# EasyEDA Pro project DartCharger.eprj, board PCB1
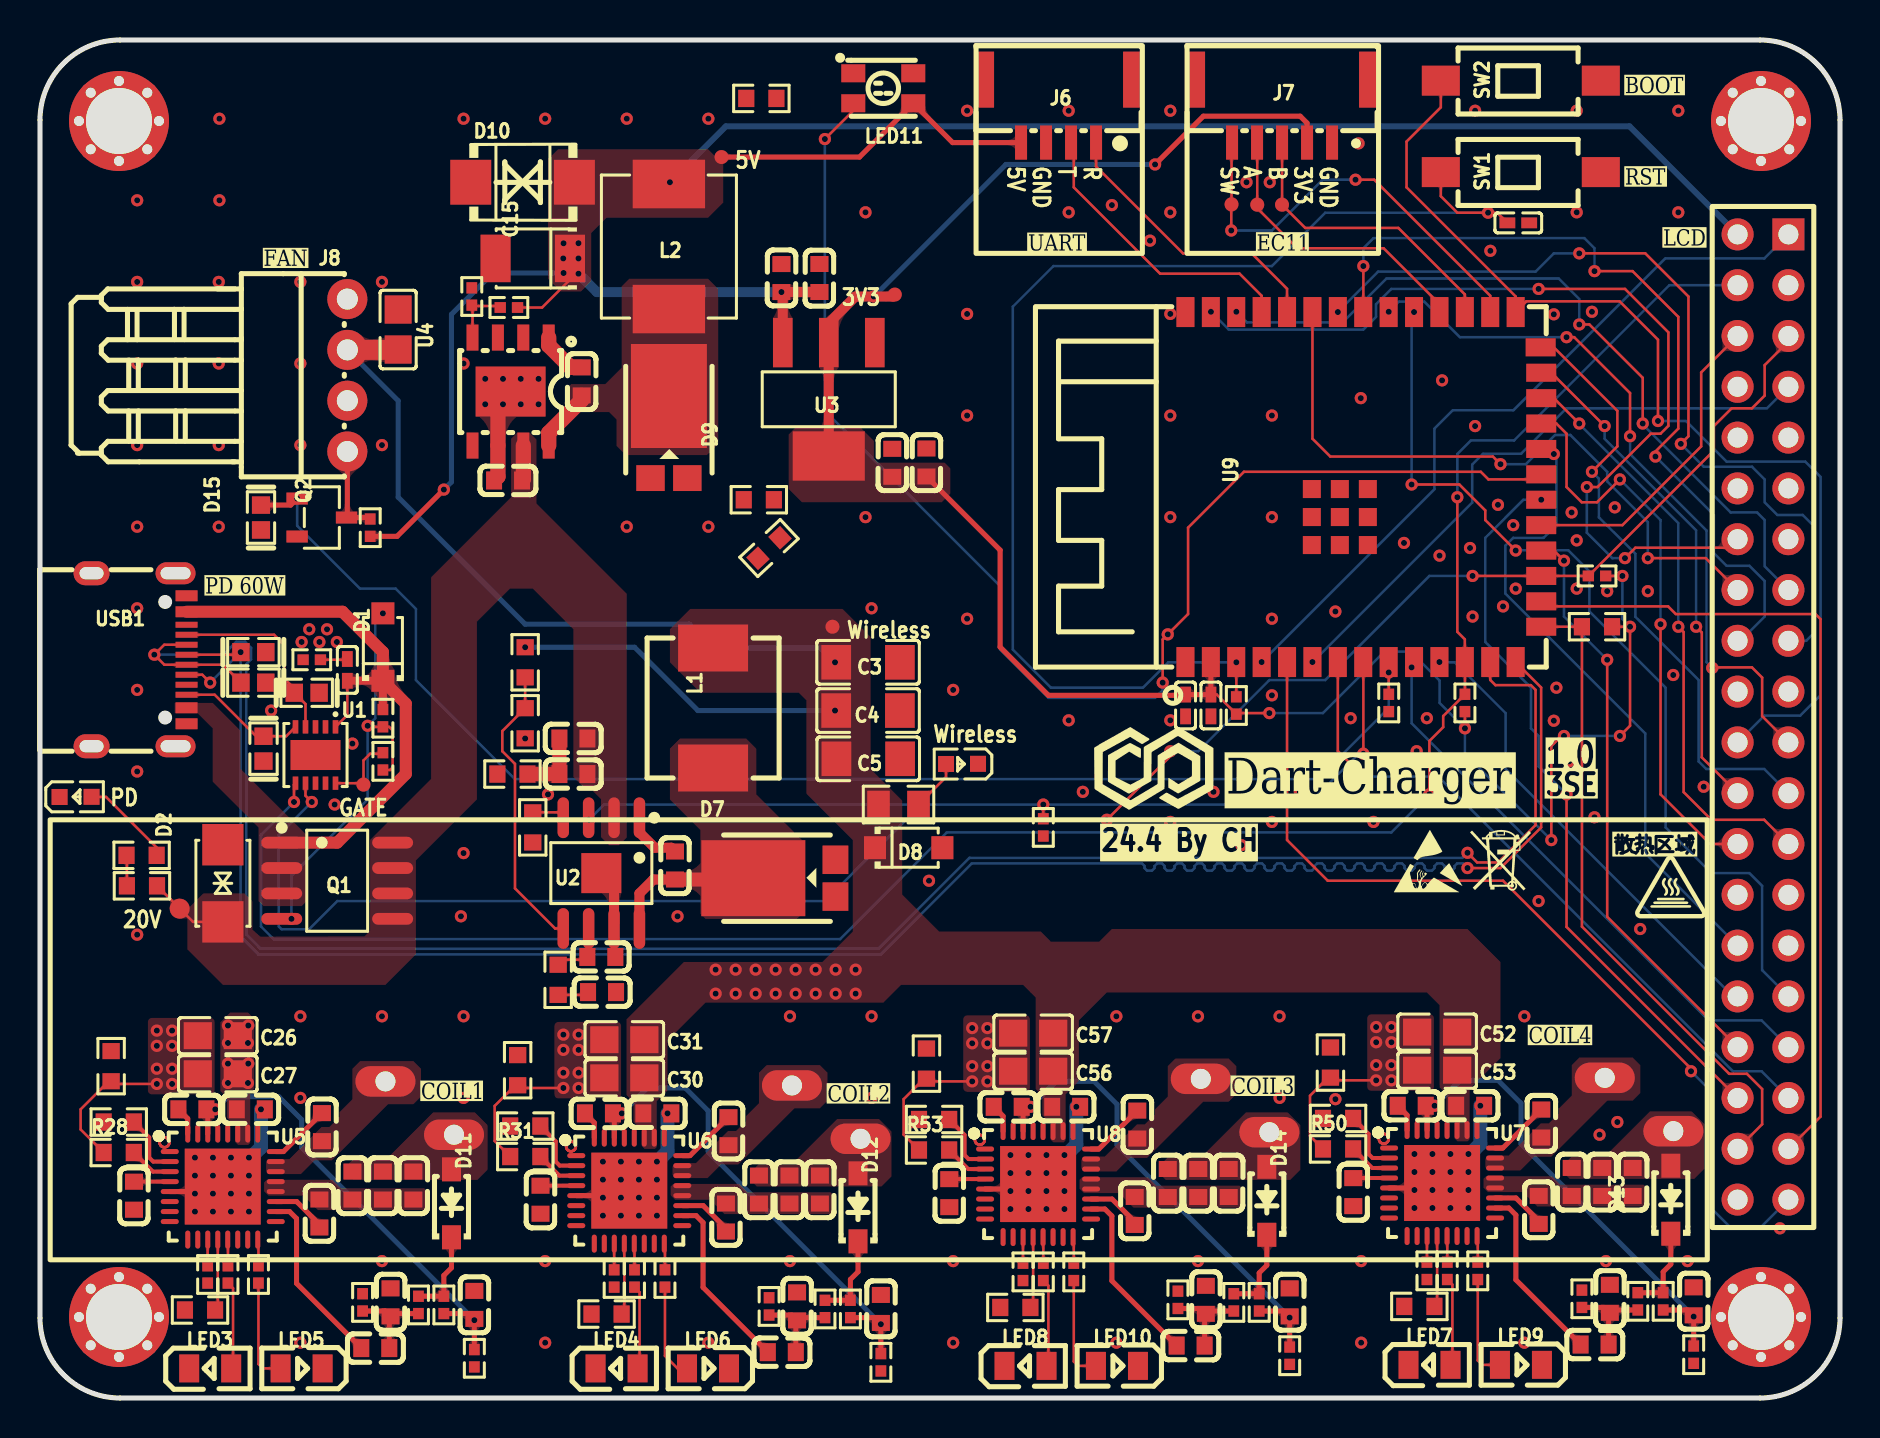
[diagram p3: board, top side]
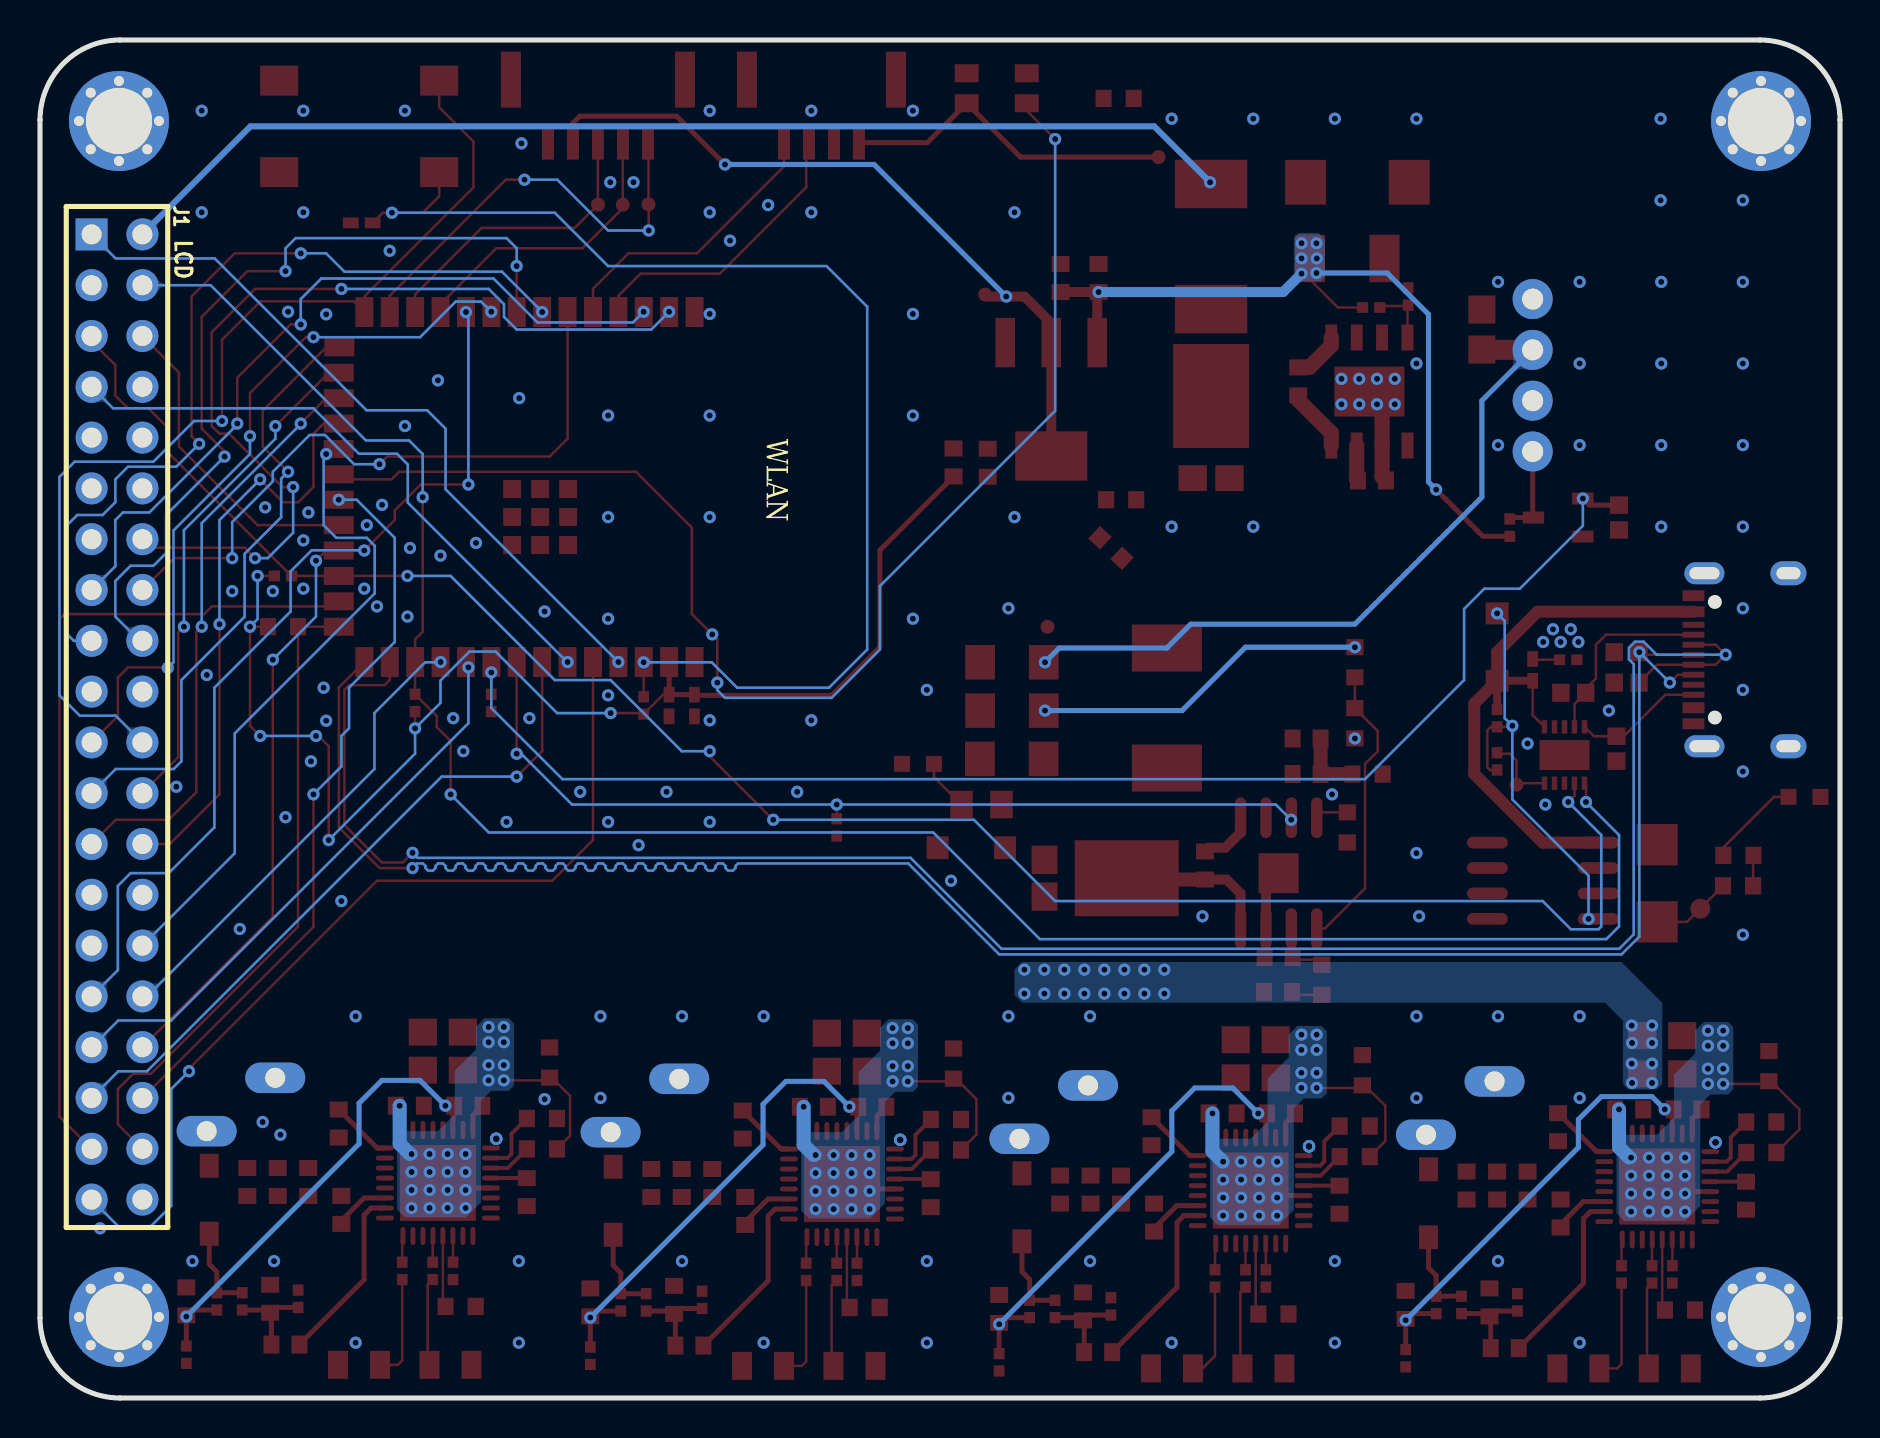
[diagram p4: board, bottom side, seen from below]

Outline 90 x 67.9 mm; copper layers: Top Layer, Bottom Layer. Coordinates in mm from the lower left corner of the outline.
Outline path: 0,63.9 0,4 arc(1.17,1.17) 4,0 86,0 arc(88.83,1.17) 90,4 90,63.9 arc(88.83,66.73) 86,67.9 4,67.9 arc(1.17,66.73) 0,63.9
Stack: Top Layer 0.035mm / Dielectric1 1.51mm FR4 er 4.5 / Bottom Layer 0.035mm

## Design rules (mm)
net USB_DN: DP1
net USB_DP: DP1
template: 自定义配置
spacing copperThickness1oz (default): track to track 0.102, other pairs 0.152 to 0.3
spacing copperThickness2oz: track to track 0.203, other pairs 0.152 to 0.3
track width copperThickness1oz (default): min 0.127, default 0.254, max 2.54
track width copperThickness2oz: min 0.203, default 0.254, max 2.54
differential pair differentialPair (default): width min 0.127, default 0.254, max 2.54; gap min 0.152, default 0.152
via viaSize (default): diameter min 0.5, default 0.61, max 10; hole min 0.3, default 0.305, max 6.3
net PGND uses copperRegion_Power
net DGND uses copperRegion_Power

## Placement (name value [footprint] x y rotation side)
C1  1uF  [C0402]  15.37 36.4 90 top
C2  100nF  [C0603]  31.75 26.62 90 top
C3  10uF  [C1206]  41.4 36.79 180 top
C4  10uF  [C1206]  41.4 34.37 180 top
C5  10uF  [C1206]  41.41 31.96 180 top
C6  2.2uF  [C0603]  26.67 32.98 0 top
C7  2.2uF  [C0603]  26.67 31.2 0 top
C8  68pF  [C0603]  28.07 22.05 0 top
C9  10uF  [C0603]  44.32 46.78 90 top
C10  100nF  [C0603]  42.61 46.76 270 top
C11  6.8nF  [C0603]  28.1 20.3 180 top
C12  10uF  [C0603]  37.07 56 270 top
C13  100nF  [C0603]  38.97 56 90 top
C14  10nF  [C0603]  27.09 50.83 90 top
C15  100uF  [CASE-B_3528]  24.64 56.98 180 top
C16  10uF  [C0603]  23.4 45.88 0 top
C17  15nF  [C0603]  16.76 2.5 180 top
C18  15nF  [C0603]  37.09 2.29 180 top
C19  15nF  [C0603]  17.53 4.78 270 top
C20  15nF  [C0603]  37.85 4.58 270 top
C21  2.2nF  [C0603]  7.62 14.43 180 top
C22  2.2nF  [C0603]  27.95 14.23 180 top
C23  2.2nF  [C0603]  21.72 4.65 270 top
C24  2.2nF  [C0603]  42.04 4.45 270 top
C25  2.2u  [C0603]  4.7 10.12 90 top
C26  22u  [C0805]  8.89 18.12 180 top
C27  22u  [C0805]  8.89 16.21 180 top
C28  100n  [C0603]  10.54 14.43 0 top
C29  2.2u  [C0603]  25.03 9.91 90 top
C30  22u  [C0805]  29.22 16.01 180 top
C31  22u  [C0805]  29.22 17.91 180 top
C32  100n  [C0603]  30.87 14.23 0 top
C33  100nF  [C0603]  14.1 13.54 270 top
C34  100nF  [C0603]  34.42 13.34 270 top
C35  100nF  [C0603]  15.62 10.62 90 top
C36  100nF  [C0603]  17.14 10.62 90 top
C37  100nF  [C0603]  37.47 10.42 90 top
C38  100nF  [C0603]  35.95 10.42 90 top
C39  10nF  [C0603]  18.67 10.62 90 top
C40  10nF  [C0603]  39 10.42 90 top
C41  100nF  [C0603]  13.97 9.23 270 top
C42  100nF  [C0603]  34.3 9.02 270 top
C43  15nF  [C0603]  77.73 2.67 180 top
C44  15nF  [C0603]  57.53 2.62 180 top
C45  15nF  [C0603]  78.49 4.96 270 top
C46  15nF  [C0603]  58.29 4.91 270 top
C47  2.2nF  [C0603]  68.59 14.61 180 top
C48  2.2nF  [C0603]  48.39 14.56 180 top
C49  2.2nF  [C0603]  82.68 4.83 270 top
C50  2.2nF  [C0603]  62.48 4.78 270 top
C51  2.2u  [C0603]  65.67 10.29 90 top
C52  22u  [C0805]  69.86 18.3 180 top
C53  22u  [C0805]  69.86 16.39 180 top
C54  100n  [C0603]  71.51 14.61 0 top
C55  2.2u  [C0603]  45.47 10.24 90 top
C56  22u  [C0805]  49.66 16.34 180 top
C57  22u  [C0805]  49.66 18.24 180 top
C58  100n  [C0603]  51.31 14.56 0 top
C59  100nF  [C0603]  75.06 13.72 270 top
C60  100nF  [C0603]  54.86 13.67 270 top
C61  100nF  [C0603]  79.64 10.8 90 top
C62  100nF  [C0603]  78.11 10.8 90 top
C63  100nF  [C0603]  56.39 10.75 90 top
C64  100nF  [C0603]  57.91 10.75 90 top
C65  10nF  [C0603]  76.59 10.8 90 top
C66  10nF  [C0603]  59.44 10.75 90 top
C67  100nF  [C0603]  74.94 9.41 270 top
C68  100nF  [C0603]  54.74 9.35 270 top
C69  1uF  [C0402]  58.55 34.63 270 top
C70  100nF  [C0402]  57.28 34.63 270 top
C71  1uF  [C0402]  73.91 58.76 0 top
C72  10uF  [C0805]  17.91 53.42 270 top
D1  VTVS12ASMF-M3-08  [SMF_L2.8-W1.8-LS3.7-FD-1]  17.14 37.55 270 top
D2  SMAJ20CA  [DO-214AC_L4.3-W2.7-LS5.0-BI]  9.14 25.74 270 top
D3  0603ESDA-05N  [D0603-BI]  10.67 35.77 180 top
D4  0603ESDA-05N  [D0603-BI]  10.67 37.29 180 top
D5  0603ESDA-05N  [D0603-BI]  13.33 35.26 180 top
D6  0603ESDA-05N  [D0603-BI]  11.18 32.47 90 top
D7  SB1045L  [TO-277_3P-L5.4-W4.0-LS6.5-TR]  37.72 25.99 0 top
D8  VTVS12ASMF-M3-08  [SMF_L2.8-W1.8-LS3.7-FD-1]  43.43 27.51 180 top
D9  SB1045L  [TO-277_3P-L5.4-W4.0-LS6.5-TR]  31.44 48.05 270 top
D10  SMBJ6.0CA  [SMB_L4.6-W3.6-LS5.3-BI]  24.13 60.79 0 top
D11  B5819W SL  [SOD-123_L2.7-W1.6-LS3.7-RD-1]  20.57 9.73 90 top
D12  B5819W SL  [SOD-123_L2.7-W1.6-LS3.7-RD-1]  40.9 9.53 90 top
D13  B5819W SL  [SOD-123_L2.7-W1.6-LS3.7-RD-1]  81.54 9.91 90 top
D14  B5819W SL  [SOD-123_L2.7-W1.6-LS3.7-RD-1]  61.34 9.86 90 top
D15  0603ESDA-05N  [D0603-BI]  11.05 44.02 90 top
J1  2.54-2*20  [HDR-TH_40P-P2.54-V-F-R2-C20-S2.54]  86.15 34.05 270 bottom
J2  Hole-3mm-JK 孔  [HOLE-3MM]  86.05 63.85 0 top
J3  Hole-3mm-JK 孔  [HOLE-3MM]  86.05 4.05 0 top
J4  Hole-3mm-JK 孔  [HOLE-3MM]  3.95 63.85 0 top
J5  Hole-3mm-JK 孔  [HOLE-3MM]  3.95 4.05 0 top
J6  WAFER-GH1.25-4PWB  [CONN-SMD_4P-P1.25_XUNPU_WAFER-GH1.25-4PWB]  50.93 64.34 180 top
J7  WAFER-GH1.25-5PWB  [CONN-SMD_5P-P1.25_XUNPU_WAFER-GH1.25-5PWB]  62.1 64.34 180 top
J8  KF2510-4AGW-GW  [CONN-TH_4P-P2.54_CAX_KF2510-4AGW-GW]  15.37 51.14 270 top
L1  10uH  [IND-SMD_L7.3-W6.8]  33.66 34.5 90 top
L2  15uH  [IND-SMD_L7.0-W6.6_FXL0630]  31.44 57.57 270 top
LED1  19-213/Y2C-CQ2R2L/3T(CY)  [LED0603-RD-YELLOW]  1.78 30.05 0 top
LED2  KT-0603R  [LED0603-RD]  46.1 31.71 180 top
LED3  KT-0805Y  [LED0805-R-RD]  8.51 1.48 0 top
LED4  KT-0805Y  [LED0805-R-RD]  28.83 1.48 0 top
LED5  KT-0805G  [LED0805-R-RD]  13.08 1.48 180 top
LED6  KT-0805G  [LED0805-R-RD]  33.4 1.48 180 top
LED7  KT-0805Y  [LED0805-R-RD]  69.48 1.66 0 top
LED8  KT-0805Y  [LED0805-R-RD]  49.28 1.61 0 top
LED9  KT-0805G  [LED0805-R-RD]  74.05 1.66 180 top
LED10  KT-0805G  [LED0805-R-RD]  53.85 1.61 180 top
LED11  XL-3528RGBW-WS2812B  [LED-SMD_4P-L3.5-W2.8-BR-1]  42.16 65.49 180 top
NOREF  -  [Pad_e5729]  61.47 13.29 0 top
NOREF#2  -  [Pad_e5130]  37.6 15.63 180 top
NOREF#3  -  [Pad_e5099]  41.03 12.96 0 top
NOREF#4  -  [Pad_e5412]  81.67 13.34 0 top
NOREF#5  -  [Pad_e5447]  78.24 16.01 180 top
NOREF#6  -  [Pad_e3895]  17.27 15.83 180 top
NOREF#7  -  [Pad_e5756]  58.04 15.96 180 top
NOREF#8  -  [Pad_e3903]  20.7 13.16 0 top
Q1  IRF9321TRPbF  [SOIC-8_L4.9-W3.9-P1.27-LS6.0-BL]  14.86 25.86 270 top
Q2  AO3400A  [SOT-23-3_L2.9-W1.6-P1.90-LS2.8-BR]  14.09 44.02 180 top
R1  10Ω  [R0402]  13.59 36.91 180 top
R2  10kΩ  [R0402]  17.14 33.99 90 top
R3  1kΩ  [R0603]  5.1 25.61 0 top
R4  5.1kΩ  [R0402]  17.14 31.83 270 top
R5  1kΩ  [R0603]  5.08 27.13 180 top
R6  143k  [R0603]  24.26 36.79 90 top
R7  680Ω  [R0805]  42.93 29.67 180 top
R8  10Ω  [R0603]  23.62 31.2 180 top
R9  243k  [R0603]  24.64 28.53 90 top
R10  10.2k  [R0603]  24.26 33.74 90 top
R11  0Ω  [R0603]  36.07 64.98 180 top
R13  13kΩ  [R0603]  25.91 20.91 90 top
R14  0Ω  [R0603]  36.45 42.5 223 top
R16  0Ω  [R0603]  35.94 44.91 180 top
R18  10kΩ  [R0402]  23.44 54.52 0 top
R19  3.3kΩ  [R0402]  21.59 55.07 270 top
R20  33k  [R0402]  16.13 4.78 270 top
R21  33k  [R0402]  36.46 4.58 270 top
R22  0Ω  [R0603]  3.94 13.8 0 top
R23  0Ω  [R0603]  24.26 13.6 0 top
R24  20mΩ  [R0603]  3.56 16.59 90 top
R25  3.3kΩ  [R0402]  18.92 4.65 90 top
R26  20mΩ  [R0603]  23.88 16.39 90 top
R27  3.3kΩ  [R0402]  39.25 4.45 90 top
R28  0Ω  [R0603]  3.94 12.27 0 top
R29  10k  [R0402]  21.72 1.99 90 top
R30  100k  [R0402]  20.19 4.65 90 top
R31  0Ω  [R0603]  24.26 12.07 0 top
R32  10k  [R0402]  42.04 1.78 90 top
R33  100k  [R0402]  40.52 4.45 90 top
R34  100kΩ  [R0402]  8.38 6.18 90 top
R35  100kΩ  [R0402]  28.71 5.98 90 top
R36  100kΩ  [R0603]  8 4.4 0 top
R37  100kΩ  [R0603]  28.33 4.2 0 top
R38  1k  [R0402]  9.4 6.18 90 top
R39  1k  [R0402]  29.72 5.98 90 top
R40  1k  [R0402]  10.92 6.18 90 top
R41  1k  [R0402]  31.25 5.98 90 top
R42  33k  [R0402]  77.1 4.96 270 top
R43  33k  [R0402]  56.9 4.91 270 top
R44  0Ω  [R0603]  64.9 13.98 0 top
R45  0Ω  [R0603]  44.7 13.93 0 top
R46  20mΩ  [R0603]  64.52 16.77 90 top
R47  3.3kΩ  [R0402]  79.89 4.83 90 top
R48  20mΩ  [R0603]  44.32 16.72 90 top
R49  3.3kΩ  [R0402]  59.69 4.78 90 top
R50  0Ω  [R0603]  64.9 12.45 0 top
R51  10k  [R0402]  82.68 2.17 90 top
R52  100k  [R0402]  81.16 4.83 90 top
R53  0Ω  [R0603]  44.7 12.4 0 top
R54  10k  [R0402]  62.48 2.11 90 top
R55  100k  [R0402]  60.96 4.78 90 top
R56  100kΩ  [R0402]  69.35 6.36 90 top
R57  100kΩ  [R0402]  49.15 6.31 90 top
R58  100kΩ  [R0603]  68.97 4.58 0 top
R59  100kΩ  [R0603]  48.77 4.53 0 top
R60  1k  [R0402]  70.36 6.36 90 top
R61  1k  [R0402]  50.16 6.31 90 top
R62  1k  [R0402]  71.89 6.36 90 top
R63  1k  [R0402]  51.69 6.31 90 top
R64  10kΩ  [R0402]  59.82 34.63 90 top
R65  10kΩ  [R0603]  77.85 38.56 180 top
R66  10kΩ  [R0402]  16.51 43.52 270 top
R67  10kΩ  [R0402]  67.44 34.75 90 top
R68  2kΩ  [R0402]  71.25 34.75 270 top
R69  2kΩ  [R0402]  77.85 41.1 0 top
R70  10kΩ  [R0402]  50.16 28.53 90 top
SW1  TS-1101-C-W  [SW-SMD_L6.0-W3.3-LS8.0]  74.04 61.3 0 top
SW2  TS-1101-C-W  [SW-SMD_L6.0-W3.3-LS8.0]  74.04 65.87 0 top
TP1  -  [test-point-0.5mm#2]  6.98 24.47 0 top
TP2  -  [test-point-0.5mm]  16.17 30.67 270 top
TP3  -  [test-point-0.5mm]  39.62 38.56 0 top
TP4  -  [test-point-0.5mm]  42.74 55.17 0 top
TP5  -  [test-point-0.5mm]  34.07 62.05 0 top
TP6  -  [test-point-0.5mm]  60.86 59.67 0 top
TP7  -  [test-point-0.5mm]  59.58 59.68 0 top
TP8  -  [test-point-0.5mm]  62.1 59.67 0 top
U1  HUSB238_002DD  [DFN-10_L3.0-W3.0-P0.50-BL-EP2.5]  13.77 32.15 180 top
U2  TPS54560DDAR  [SOIC-8_L5.0-W4.0-P1.27-LS6.0-BL-EP2.0]  28.07 26.24 180 top
U3  AMS1117-3.3  [SOT-223-4_L6.5-W3.5-P2.30-LS7.0-BR]  39.44 49.94 90 top
U4  TPS5430DDAR  [ESOP-8_L4.9-W3.9-P1.27-LS6.0-TL-EP]  23.53 50.32 270 top
U5  IP6826  [QFN-32_L5.0-W5.0-P0.50-BL-EP3.8]  9.14 10.57 270 top
U6  IP6826  [QFN-32_L5.0-W5.0-P0.50-BL-EP3.8]  29.46 10.37 270 top
U7  IP6826  [QFN-32_L5.0-W5.0-P0.50-BL-EP3.8]  70.1 10.75 270 top
U8  IP6826  [QFN-32_L5.0-W5.0-P0.50-BL-EP3.8]  49.9 10.7 270 top
U9  ESP32-S3-WROOM-1-N8R8  [WIRELM-SMD_ESP32-S3-WROOM-1]  66.17 45.55 90 top
USB1  TYPE-C 16PIN 2MD(073)  [USB-C-SMD_TYPE-C-6PIN-2MD-073]  4.95 36.91 270 top

## Footprints (pads in the part's own frame, mm; a bottom-side part is the same pattern mirrored in y, then rotated)
C0402
  rect 0.79x0.54 smd: 1(-0.545,0) 2(0.545,0)
C0603
  rect 0.8x0.9 smd: 1(-0.7,0) 2(0.7,0)
C0805
  rect 1.41x1.35 smd: 1(-1,0) 2(1,0)
C1206
  rect 1.485x1.728 smd: 1(-1.593,0) 2(1.593,0)
CASE-B_3528
  rect 1.506x2.376 smd: 1(-1.861,0) 2(1.861,0)
CONN-SMD_4P-P1.25_XUNPU_WAFER-GH1.25-4PWB
  rect 0.6x1.7 smd: 1(-1.875,1.575) 2(-0.625,1.575) 3(0.625,1.575) 4(1.875,1.575)
  rect 1x2.8 smd: 5(3.725,-1.575) 6(-3.725,-1.575)
CONN-SMD_5P-P1.25_XUNPU_WAFER-GH1.25-5PWB
  rect 0.6x1.7 smd: 1(-2.5,1.575) 2(-1.25,1.575) 3(-0.001,1.575) 4(1.25,1.575) 5(2.5,1.575)
  rect 1x2.8 smd: 6(4.35,-1.575) 7(-4.35,-1.575)
CONN-TH_4P-P2.54_CAX_KF2510-4AGW-GW
  round 2 hole 1.05: 1(-3.81,0) 2(-1.27,0) 3(1.27,0) 4(3.81,0)
D0603-BI
  rect 0.873x0.907 smd: 1(-0.622,0) 2(0.622,0)
DFN-10_L3.0-W3.0-P0.50-BL-EP2.5
  rect 0.28x0.665 smd: 1(-1,-1.407) 2(-0.5,-1.407) 3(0,-1.407) 4(0.5,-1.407) 5(1,-1.407) 6(1,1.407) 7(0.5,1.407) 8(0,1.407) 9(-0.5,1.407) 10(-1,1.407)
  rect 2.5x1.5 smd: 11(0,0)
DO-214AC_L4.3-W2.7-LS5.0-BI
  rect 2.07x2.06 smd: 1(-1.929,0) 2(1.929,0)
ESOP-8_L4.9-W3.9-P1.27-LS6.0-TL-EP
  rect 1.3x0.6 smd: 1(-2.7,1.905) 2(-2.7,0.635) 3(-2.7,-0.635) 4(-2.7,-1.905) 5(2.7,-1.905) 6(2.7,-0.635) 7(2.7,0.635) 8(2.7,1.905)
  rect 2.5x3.5 smd: 9(0,0)
HDR-TH_40P-P2.54-V-F-R2-C20-S2.54
  rect 1.6x1.6 hole 1: 1(-24.13,-1.27)
  round 1.6 hole 1: 2(-24.13,1.27) 3(-21.59,-1.27) 4(-21.59,1.27) 5(-19.05,-1.27) 6(-19.05,1.27) 7(-16.51,-1.27) 8(-16.51,1.27) 9(-13.97,-1.27) 10(-13.97,1.27) 11(-11.43,-1.27) 12(-11.43,1.27) 13(-8.89,-1.27) 14(-8.89,1.27) 15(-6.35,-1.27) 16(-6.35,1.27) 17(-3.81,-1.27) 18(-3.81,1.27) 19(-1.27,-1.27) 20(-1.27,1.27) 21(1.27,-1.27) 22(1.27,1.27) 23(3.81,-1.27) 24(3.81,1.27) 25(6.35,-1.27) 26(6.35,1.27) 27(8.89,-1.27) 28(8.89,1.27) 29(11.43,-1.27) 30(11.43,1.27) 31(13.97,-1.27) 32(13.97,1.27) 33(16.51,-1.27) 34(16.51,1.27) 35(19.05,-1.27) 36(19.05,1.27) 37(21.59,-1.27) 38(21.59,1.27) 39(24.13,-1.27) 40(24.13,1.27)
HOLE-3MM
  round 1 hole 0.5: 0(-2,0) 0(-1.414,1.414) 0(-1.414,-1.414) 0(0,2) 0(0,-2) 0(1.414,1.414) 0(1.414,-1.414) 0(2,0)
  round 5 hole 3.302x3: 0(0,0)
IND-SMD_L7.0-W6.6_FXL0630
  rect 2.424x3.62 smd: 1(3.128,0) 2(-3.128,0)
IND-SMD_L7.3-W6.8
  rect 2.35x3.5 smd: 1(-3,0) 2(3,0)
LED0603-RD
  rect 0.8x0.8 smd: 1(-0.799,-0.004) 2(0.799,0.004)
LED0603-RD-YELLOW
  rect 0.8x0.8 smd: 1(-0.799,-0.004) 2(0.799,0.004)
LED0805-R-RD
  rect 1x1.399 smd: 1(1.05,0) 2(-1.05,0)
LED-SMD_4P-L3.5-W2.8-BR-1
  rect 1.2x0.9 smd: 1(1.5,-0.75) 2(1.5,0.75) 3(-1.5,0.75) 4(-1.5,-0.75)
Pad_e3895
  oval 3x1.524 hole 1: 1(0,0)
Pad_e3903
  oval 3x1.524 hole 1: 1(0,0)
Pad_e5099
  oval 3x1.524 hole 1: 1(0,0)
Pad_e5130
  oval 3x1.524 hole 1: 1(0,0)
Pad_e5412
  oval 3x1.524 hole 1: 1(0,0)
Pad_e5447
  oval 3x1.524 hole 1: 1(0,0)
Pad_e5729
  oval 3x1.524 hole 1: 1(0,0)
Pad_e5756
  oval 3x1.524 hole 1: 1(0,0)
QFN-32_L5.0-W5.0-P0.50-BL-EP3.8
  oval 0.25x0.9 smd: 1(-1.75,-2.65) 2(-1.25,-2.65) 3(-0.749,-2.65) 4(-0.249,-2.65) 5(0.249,-2.65) 6(0.75,-2.65) 7(1.25,-2.65) 8(1.75,-2.65) 17(1.75,2.65) 18(1.25,2.65) 19(0.75,2.65) 20(0.249,2.65) 21(-0.249,2.65) 22(-0.749,2.65) 23(-1.25,2.65) 24(-1.75,2.65)
  oval 0.9x0.25 smd: 9(2.65,-1.75) 10(2.65,-1.25) 11(2.65,-0.75) 12(2.65,-0.249) 13(2.65,0.249) 14(2.65,0.749) 15(2.65,1.25) 16(2.65,1.75) 25(-2.65,1.75) 26(-2.65,1.25) 27(-2.65,0.749) 28(-2.65,0.249) 29(-2.65,-0.249) 30(-2.65,-0.75) 31(-2.65,-1.25) 32(-2.65,-1.75)
  rect 3.8x3.8 smd: 33(0,0)
R0402
  rect 0.566x0.54 smd: 1(-0.433,0) 2(0.433,0)
R0603
  rect 0.806x0.864 smd: 1(-0.753,0) 2(0.753,0)
R0805
  rect 1.133x1.377 smd: 1(-1,0) 2(1,0)
SMB_L4.6-W3.6-LS5.3-BI
  rect 2.047x2.241 smd: 1(-2.591,0) 2(2.591,0)
SMF_L2.8-W1.8-LS3.7-FD-1
  rect 1.1x1.15 smd: 1(-1.685,0) 2(1.685,0)
SOD-123_L2.7-W1.6-LS3.7-RD-1
  rect 1.2x0.95 smd: 1(-1.7,0) 2(1.7,0)
SOIC-8_L4.9-W3.9-P1.27-LS6.0-BL
  oval 0.588x2.045 smd: 1(-1.905,-2.772) 2(-0.635,-2.772) 3(0.635,-2.772) 4(1.905,-2.772) 5(1.905,2.772) 6(0.635,2.772) 7(-0.635,2.772) 8(-1.905,2.772)
SOIC-8_L5.0-W4.0-P1.27-LS6.0-BL-EP2.0
  oval 0.574x2.038 smd: 1(-1.905,-2.769) 2(-0.635,-2.769) 3(0.635,-2.769) 4(1.905,-2.769) 5(1.905,2.769) 6(0.635,2.769) 7(-0.635,2.769) 8(-1.905,2.769)
  rect 2x2 smd: 9(0,0)
SOT-23-3_L2.9-W1.6-P1.90-LS2.8-BR
  rect 1.07x0.6 smd: 1(1.235,-0.95) 2(1.235,0.95) 3(-1.235,0)
SOT-223-4_L6.5-W3.5-P2.30-LS7.0-BR
  rect 2.47x0.98 smd: 1(2.835,-2.3) 2(2.835,0) 3(2.835,2.3)
  rect 2.47x3.6 smd: 4(-2.835,0)
SW-SMD_L6.0-W3.3-LS8.0
  rect 1.9x1.5 smd: 1(-4,0) 2(4,0)
test-point-0.5mm
  round 0.7 smd: 1(0,0)
test-point-0.5mm#2
  round 1 smd: 1(0,0)
TO-277_3P-L5.4-W4.0-LS6.5-TR
  rect 1.29x1.423 smd: 1(2.054,0.92) 3(2.054,-0.92)
  rect 5.2x3.8 smd: 2(-2.054,0)
USB-C-SMD_TYPE-C-6PIN-2MD-073
  rect 0.55x1.1 smd: 1(-3.2,2.375) 2(-2.4,2.375) 11(2.4,2.375) 12(3.2,2.375)
  rect 0.3x1.1 smd: 3(-1.75,2.375) 4(-1.25,2.375) 5(-0.75,2.375) 6(-0.25,2.375) 7(0.25,2.375) 8(0.75,2.375) 9(1.25,2.375) 10(1.75,2.375)
  oval 1.1x2 hole 0.6x1.5: 13(-4.325,1.825) 14(4.325,1.825)
  oval 1.2x1.8 hole 0.6x1.2: 13(-4.325,-2.375) 14(4.325,-2.375)
WIRELM-SMD_ESP32-S3-WROOM-1
  rect 1.5x0.9 smd: 1(-8.75,8.895) 2(-8.75,7.625) 3(-8.75,6.355) 4(-8.75,5.085) 5(-8.75,3.815) 6(-8.75,2.545) 7(-8.75,1.275) 8(-8.75,0.005) 9(-8.75,-1.265) 10(-8.75,-2.535) 11(-8.75,-3.805) 12(-8.75,-5.075) 13(-8.75,-6.345) 14(-8.75,-7.615) 27(8.75,-7.615) 28(8.75,-6.345) 29(8.75,-5.075) 30(8.75,-3.805) 31(8.75,-2.535) 32(8.75,-1.265) 33(8.75,0.005) 34(8.75,1.275) 35(8.75,2.545) 36(8.75,3.815) 37(8.75,5.085) 38(8.75,6.355) 39(8.75,7.625) 40(8.75,8.895)
  rect 0.9x1.5 smd: 15(-6.985,-8.895) 16(-5.715,-8.895) 17(-4.445,-8.895) 18(-3.175,-8.895) 19(-1.905,-8.895) 20(-0.635,-8.895) 21(0.635,-8.895) 22(1.905,-8.895) 23(3.175,-8.895) 24(4.445,-8.895) 25(5.715,-8.895) 26(6.985,-8.865)
  rect 0.9x0.9 smd: 41(-2.9,2.575) 41(-2.9,1.175) 41(-2.9,-0.225) 41(-1.5,2.575) 41(-1.5,1.175) 41(-1.5,-0.225) 41(-0.1,2.575) 41(-0.1,1.175) 41(-0.1,-0.225)

## Nets
As in the schematic, except:
COIL_1+: C35.2 C36.2 C39.2 D11.2 NOREF#8.1
COIL_1-: C33.2 NOREF#6.1 U5.22 U5.23
COIL_2+: C37.2 C38.2 C40.2 D12.2 NOREF#3.1
COIL_2-: C34.2 NOREF#2.1 U6.22 U6.23
COIL_3+: C63.2 C64.2 C66.2 D14.2 NOREF.1
COIL_3-: C60.2 NOREF#7.1 U8.22 U8.23
COIL_4+: C61.2 C62.2 C65.2 D13.2 NOREF#4.1
COIL_4-: C59.2 NOREF#5.1 U7.22 U7.23

Pads without a net: J1 3 9 10 11 12 13 19 20 27 28 29; J2 0; J3 0; J4 0; J5 0; J8 3; LED11 4; U1 2 3 8 9; U4 2 3 5; U5 6 7 8 9 10 14 15 17 25 28 29 31; U6 6 7 8 9 10 14 15 17 25 28 29 31; U7 6 7 8 9 10 14 15 17 25 28 29 31; U8 6 7 8 9 10 14 15 17 25 28 29 31; USB1 3 9

## Via types
v1: diameter 0.61, hole 0.304, Top Layer to Bottom Layer, 85 vias
v2: diameter 0.61, hole 0.305, Top Layer to Bottom Layer, 307 vias
